# Altium schematic sheet 0224_GPU POWER_ GROUND.SchDoc
size 848 x 558 mm
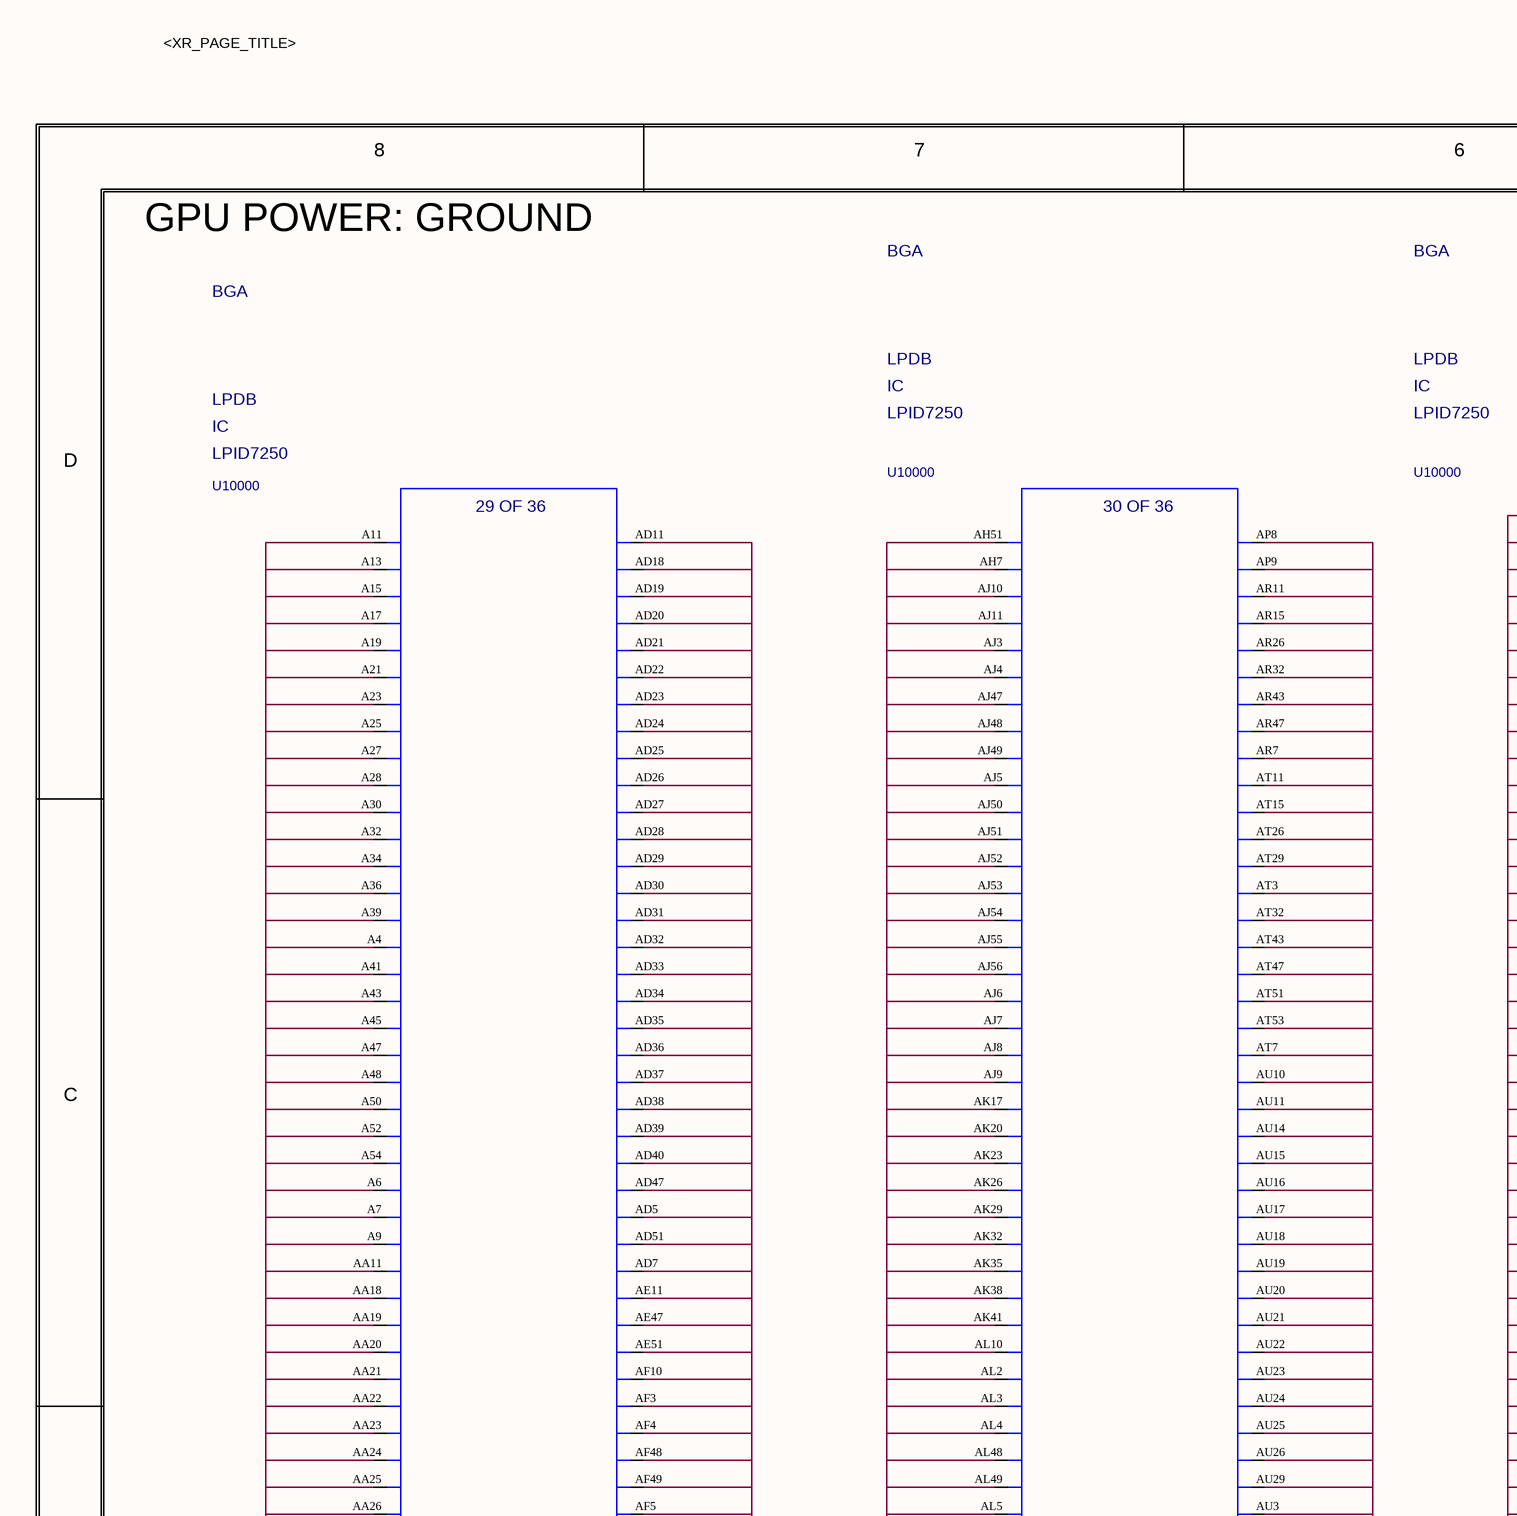
[diagram p0: 0224_GPU POWER_ GROUND.SchDoc, top left]
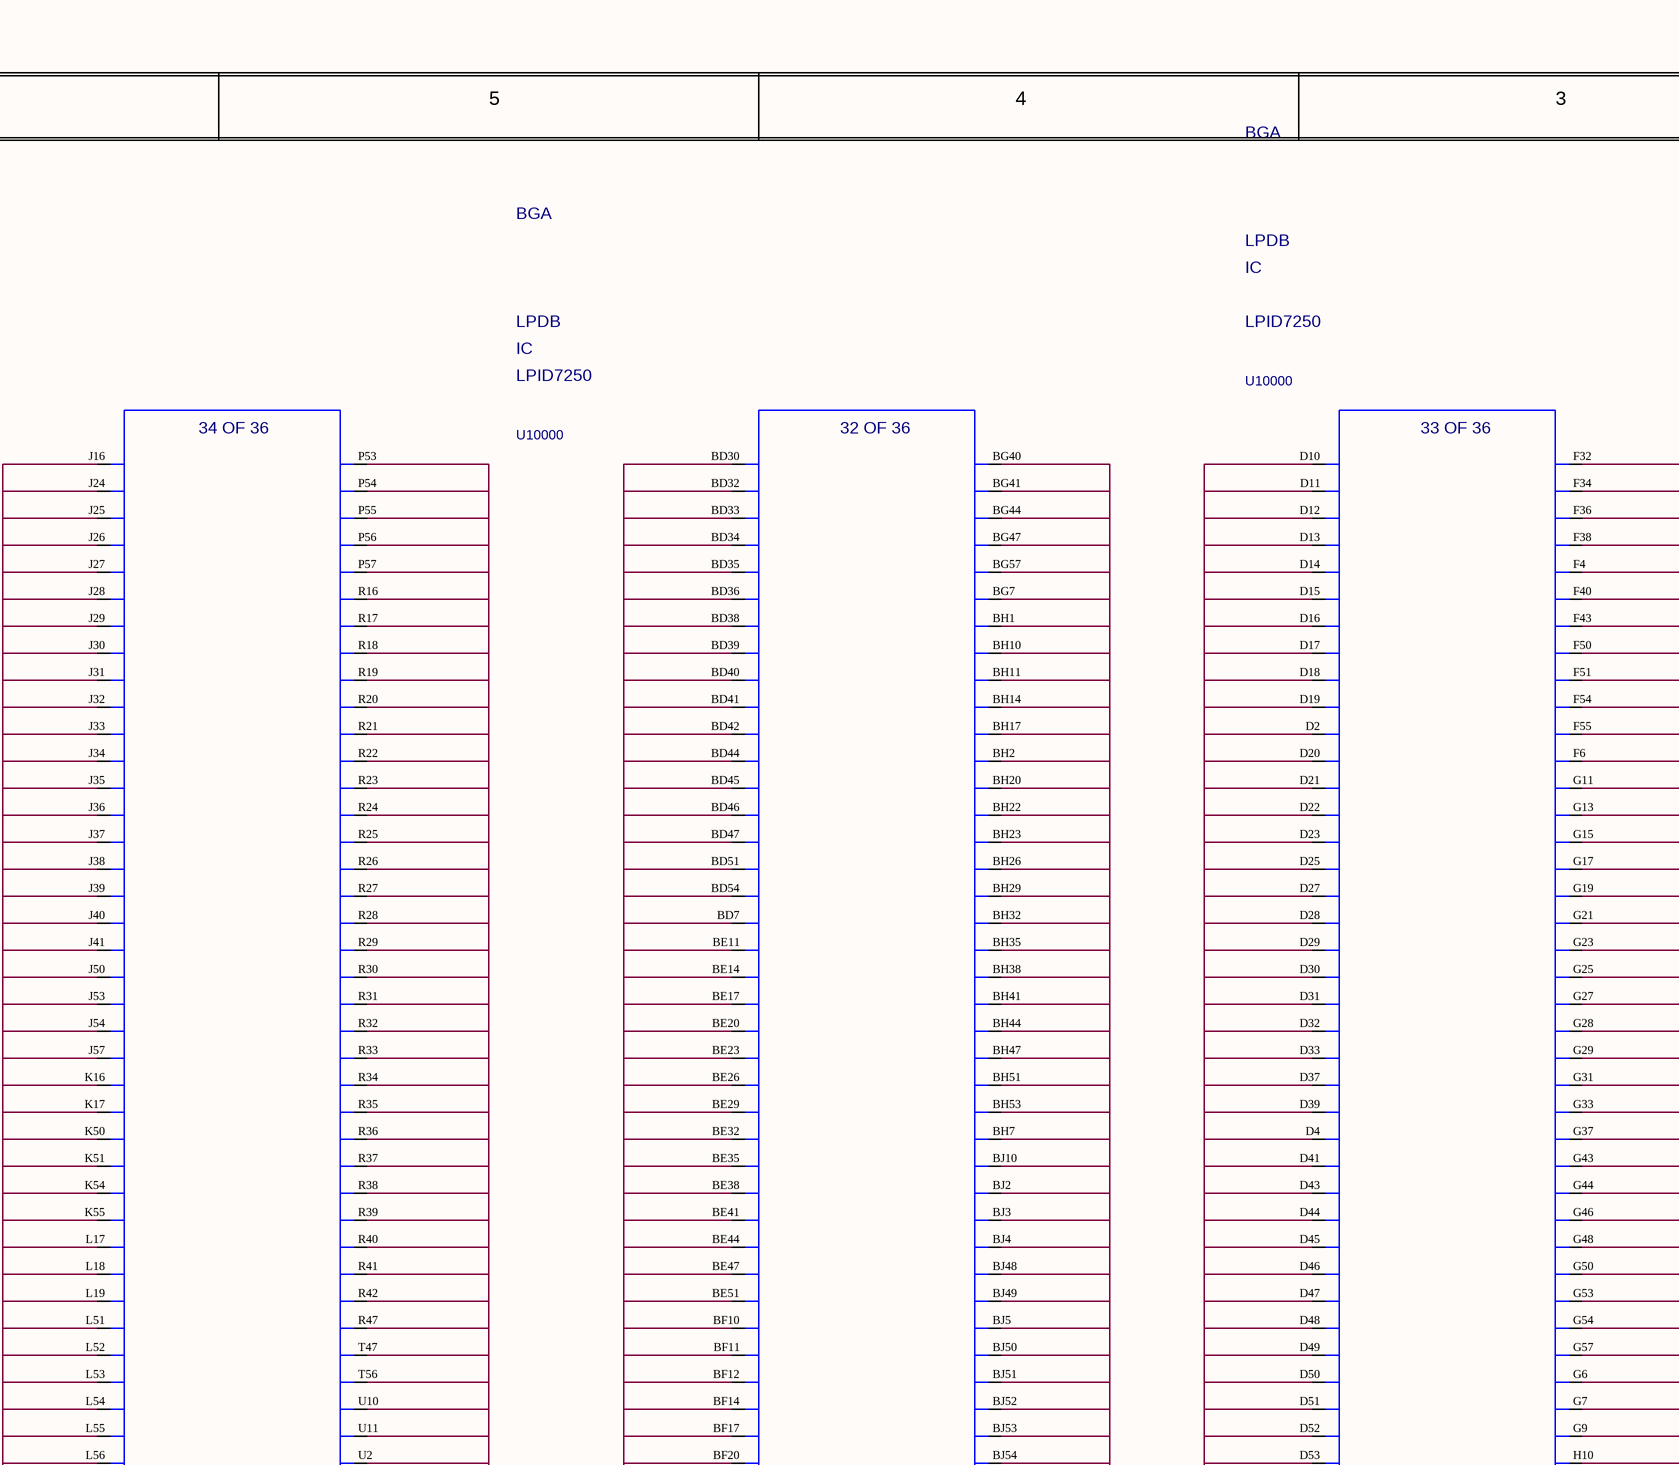
[diagram p1: 0224_GPU POWER_ GROUND.SchDoc, top middle]
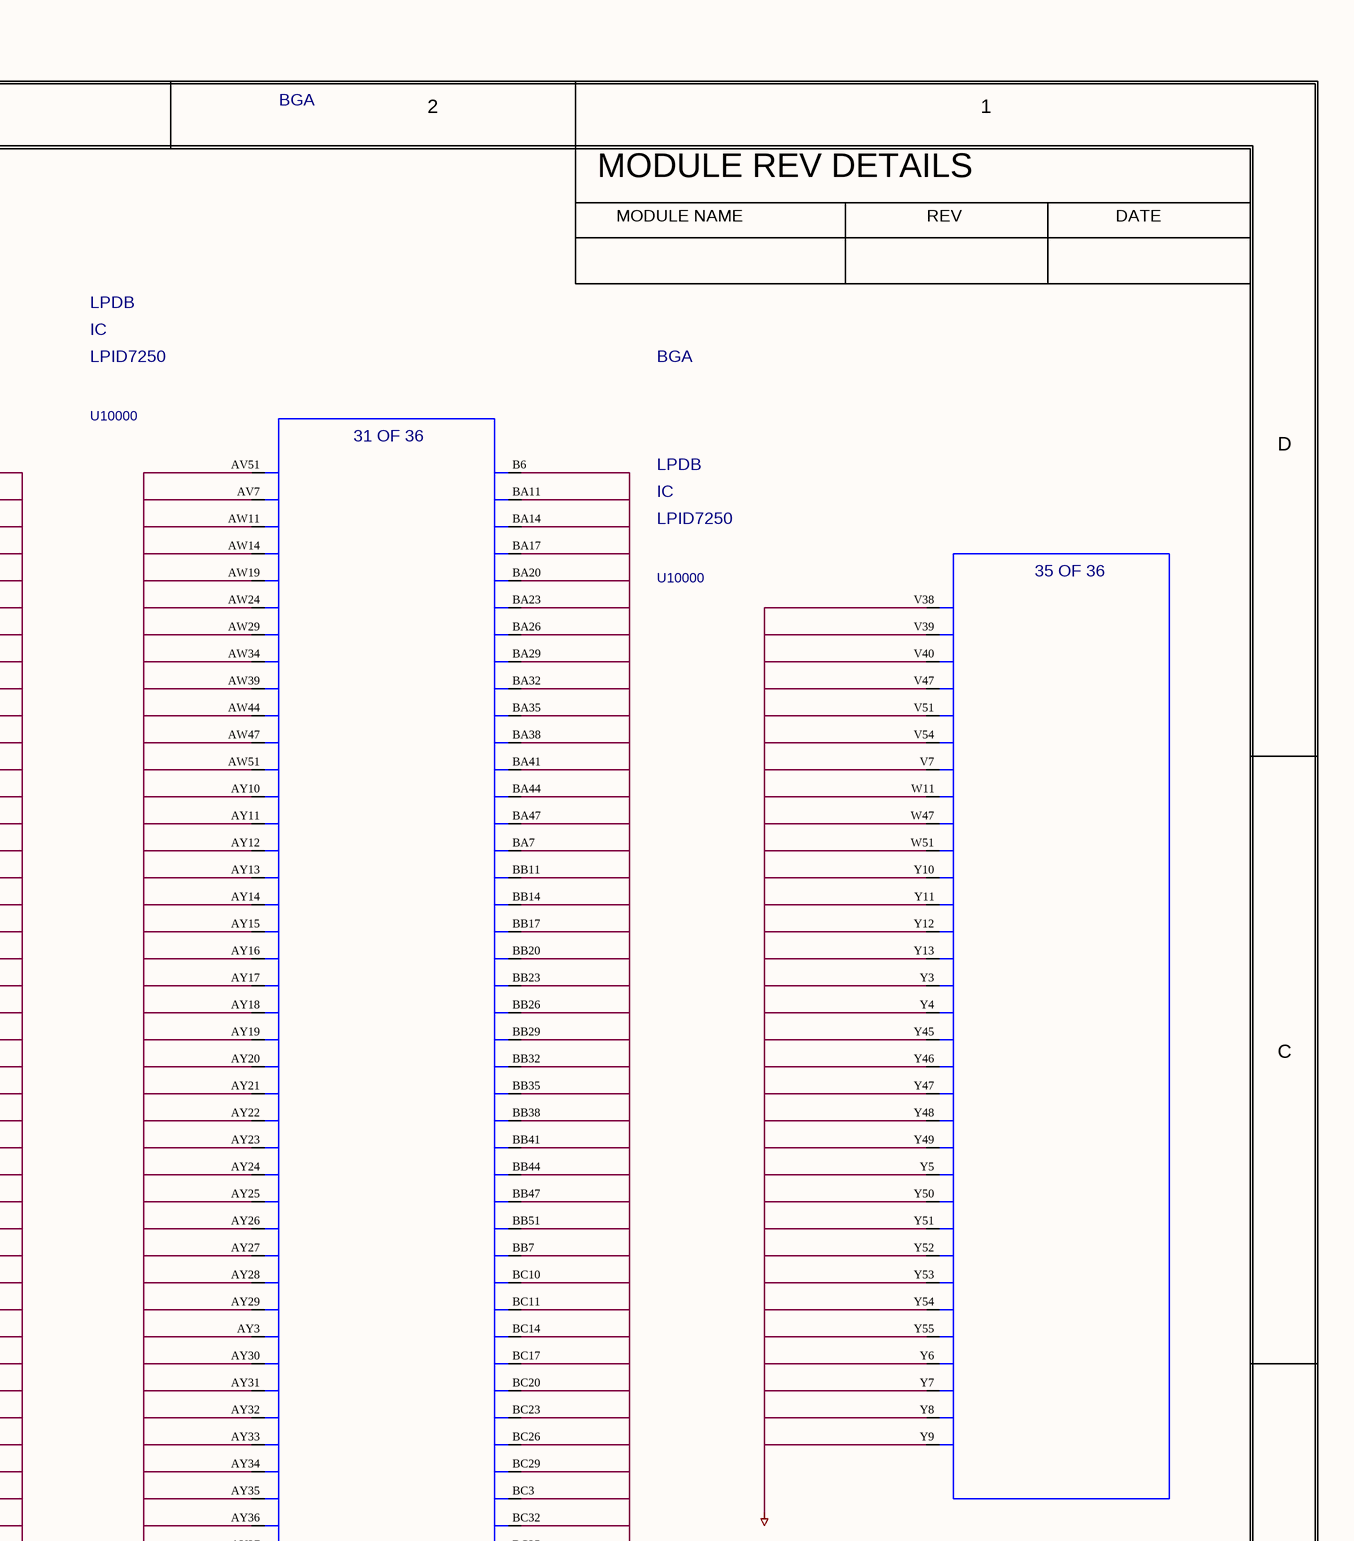
[diagram p2: 0224_GPU POWER_ GROUND.SchDoc, top right]
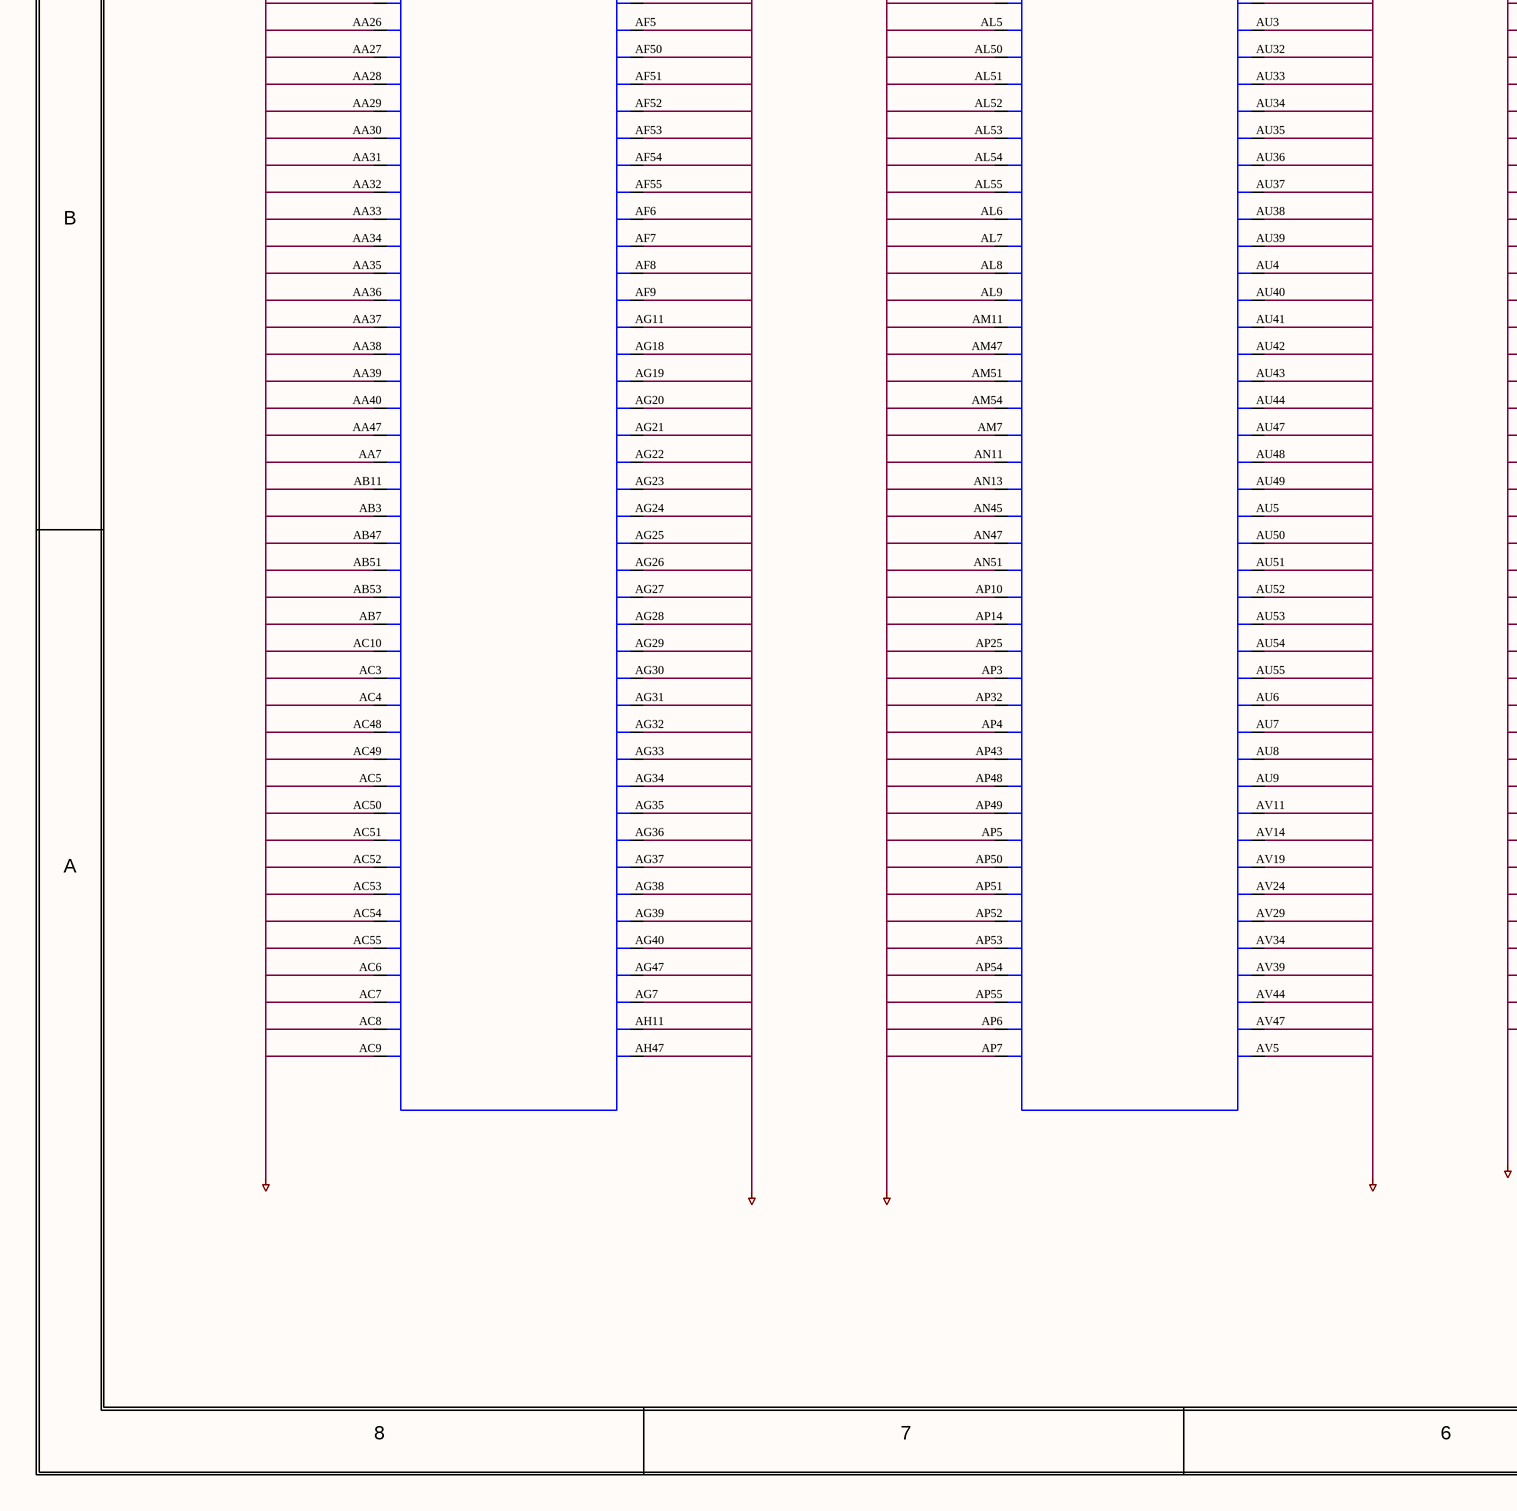
[diagram p3: 0224_GPU POWER_ GROUND.SchDoc, bottom left]
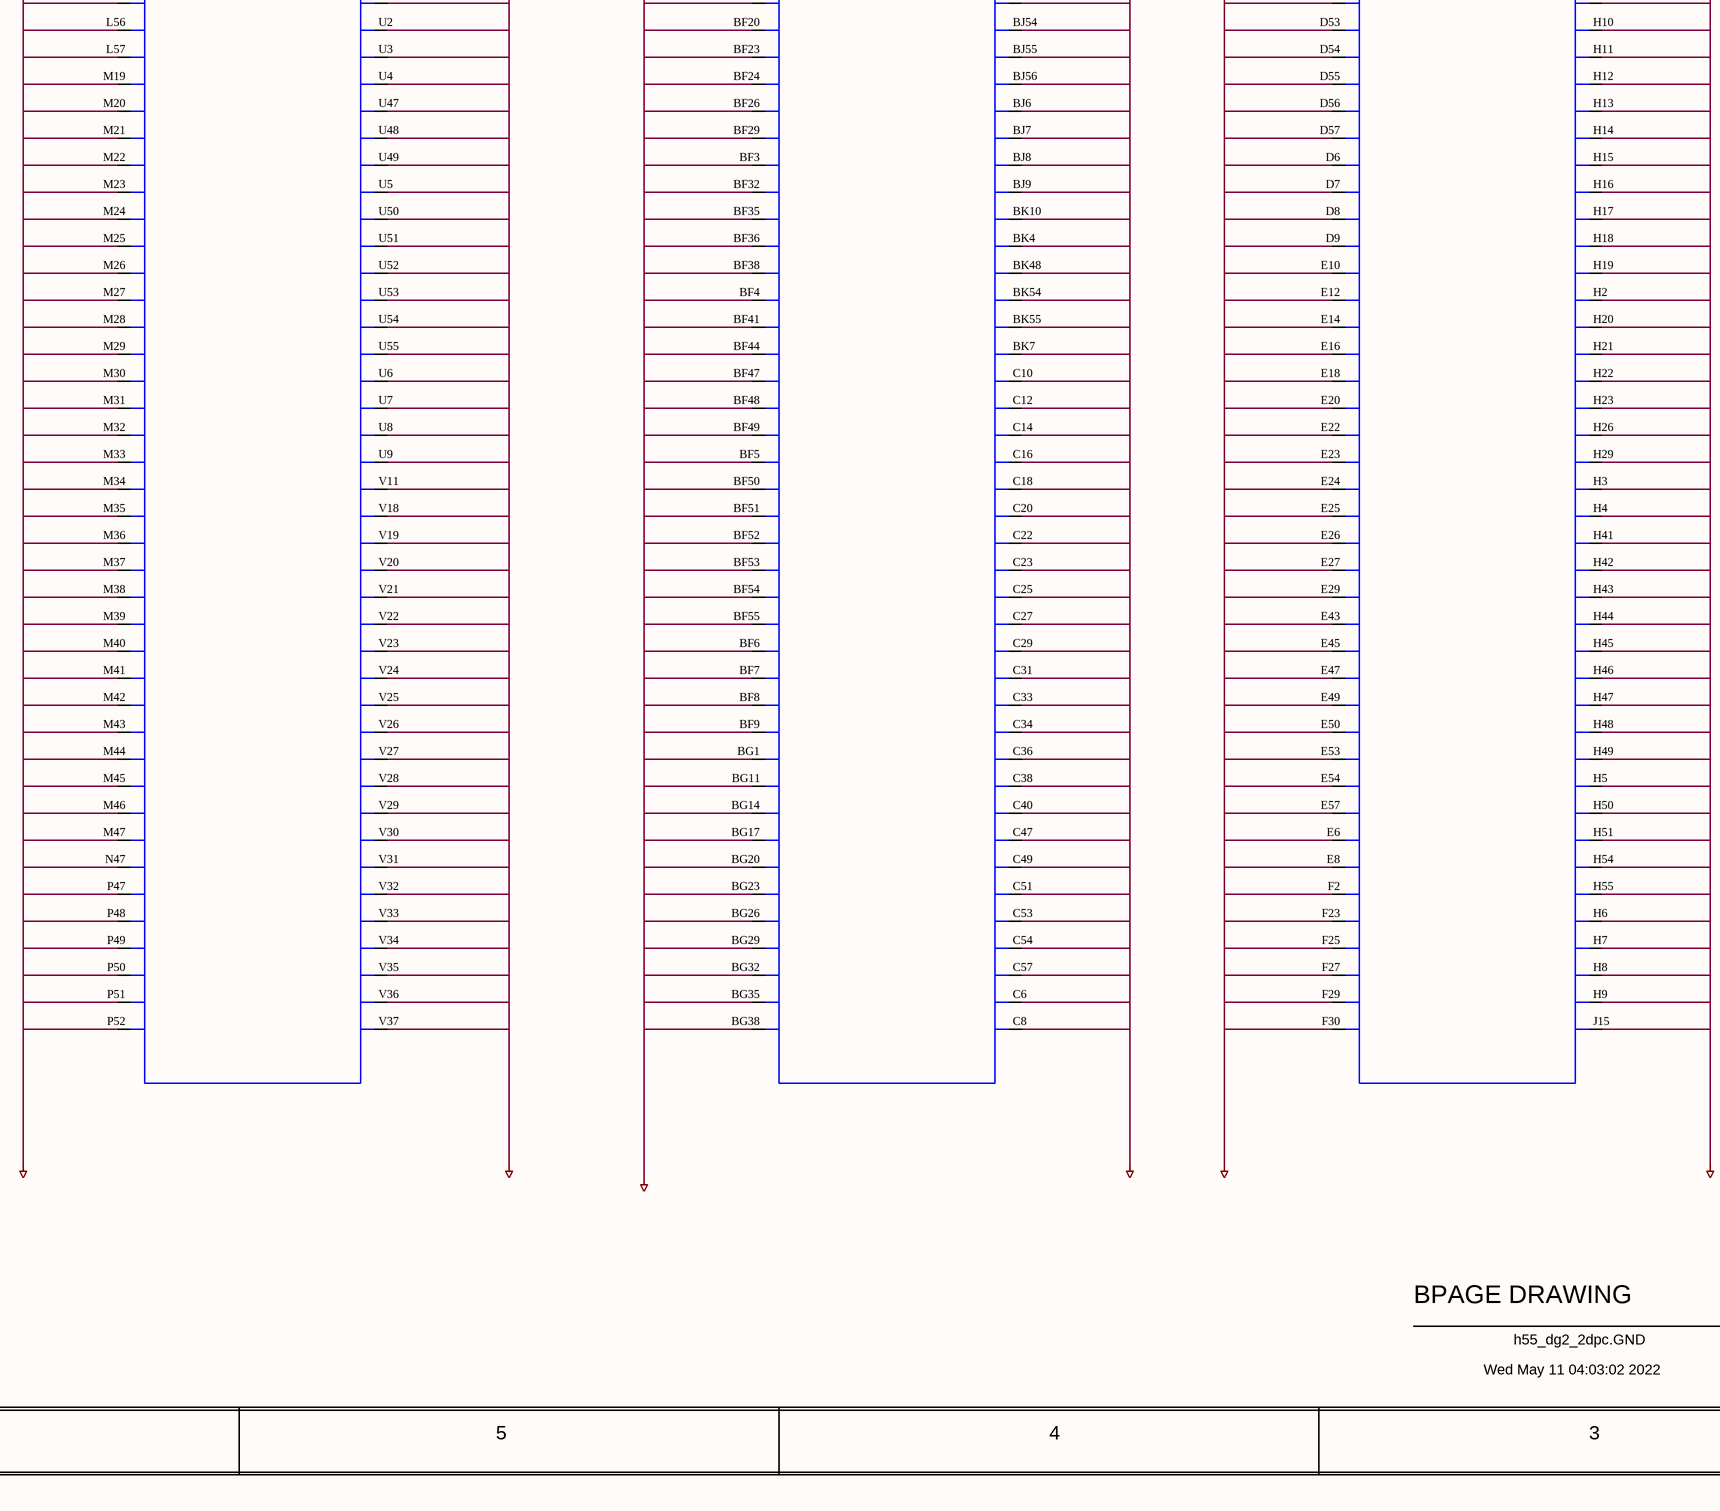
[diagram p4: 0224_GPU POWER_ GROUND.SchDoc, bottom middle]